# EAGLE board Resistor_Resistor (EAGLE 8.3.0), part 27 of 32
## Placement (x,y rotation side) (continued)
R32948  10K  [0201]  225.3,90.88 0 top
R32949  10K  [0201]  225.3,91.49 0 top
R32950  10K  [0201]  225.3,92.1 0 top
R32951  10K  [0201]  225.3,92.71 0 top
R32952  10K  [0201]  225.3,93.32 0 top
R32953  10K  [0201]  225.3,93.93 0 top
R32954  10K  [0201]  225.3,94.54 0 top
R32955  10K  [0201]  225.3,95.15 0 top
R32956  10K  [0201]  225.3,95.76 0 top
R32957  10K  [0201]  225.3,96.37 0 top
R32958  10K  [0201]  225.3,96.98 0 top
R32959  10K  [0201]  225.3,97.59 0 top
R32960  10K  [0201]  225.3,98.2 0 top
R32961  10K  [0201]  225.3,98.81 0 top
R32962  10K  [0201]  225.3,99.42 0 top
R32963  10K  [0201]  225.3,100.03 0 top
R32964  10K  [0201]  225.3,100.63 0 top
R32965  10K  [0201]  225.3,101.24 0 top
R32966  10K  [0201]  225.3,101.85 0 top
R32967  10K  [0201]  225.3,102.46 0 top
R32968  10K  [0201]  225.3,103.07 0 top
R32969  10K  [0201]  225.3,103.68 0 top
R32970  10K  [0201]  225.3,104.29 0 top
R32971  10K  [0201]  225.3,104.9 0 top
R32972  10K  [0201]  225.3,105.51 0 top
R32973  10K  [0201]  225.3,106.12 0 top
R32974  10K  [0201]  225.3,106.73 0 top
R32975  10K  [0201]  225.3,107.34 0 top
R32976  10K  [0201]  225.3,107.95 0 top
R32977  10K  [0201]  225.3,108.56 0 top
R32978  10K  [0201]  225.3,109.17 0 top
R32979  10K  [0201]  225.3,109.78 0 top
R32980  10K  [0201]  225.3,110.39 0 top
R32981  10K  [0201]  225.3,111 0 top
R32982  10K  [0201]  225.3,111.61 0 top
R32983  10K  [0201]  225.3,112.22 0 top
R32984  10K  [0201]  225.3,112.83 0 top
R32985  10K  [0201]  225.3,113.44 0 top
R32986  10K  [0201]  225.3,114.05 0 top
R32987  10K  [0201]  225.3,114.66 0 top
R32988  10K  [0201]  225.3,115.27 0 top
R32989  10K  [0201]  225.3,115.87 0 top
R32990  10K  [0201]  225.3,116.48 0 top
R32991  10K  [0201]  225.3,117.09 0 top
R32992  10K  [0201]  225.3,117.7 0 top
R32993  10K  [0201]  225.3,118.31 0 top
R32994  10K  [0201]  225.3,118.92 0 top
R32995  10K  [0201]  225.3,119.53 0 top
R32996  10K  [0201]  225.3,120.14 0 top
R32997  10K  [0201]  225.3,120.75 0 top
R32998  10K  [0201]  225.3,121.36 0 top
R32999  10K  [0201]  225.3,121.97 0 top
R33000  10K  [0201]  225.3,122.58 0 top
R33001  10K  [0201]  226.52,1.27 0 top
R33002  10K  [0201]  226.52,1.88 0 top
R33003  10K  [0201]  226.52,2.49 0 top
R33004  10K  [0201]  226.52,3.1 0 top
R33005  10K  [0201]  226.52,3.71 0 top
R33006  10K  [0201]  226.52,4.32 0 top
R33007  10K  [0201]  226.52,4.93 0 top
R33008  10K  [0201]  226.52,5.54 0 top
R33009  10K  [0201]  226.52,6.15 0 top
R33010  10K  [0201]  226.52,6.76 0 top
R33011  10K  [0201]  226.52,7.37 0 top
R33012  10K  [0201]  226.52,7.98 0 top
R33013  10K  [0201]  226.52,8.59 0 top
R33014  10K  [0201]  226.52,9.19 0 top
R33015  10K  [0201]  226.52,9.8 0 top
R33016  10K  [0201]  226.52,10.41 0 top
R33017  10K  [0201]  226.52,11.02 0 top
R33018  10K  [0201]  226.52,11.63 0 top
R33019  10K  [0201]  226.52,12.24 0 top
R33020  10K  [0201]  226.52,12.85 0 top
R33021  10K  [0201]  226.52,13.46 0 top
R33022  10K  [0201]  226.52,14.07 0 top
R33023  10K  [0201]  226.52,14.68 0 top
R33024  10K  [0201]  226.52,15.29 0 top
R33025  10K  [0201]  226.52,15.9 0 top
R33026  10K  [0201]  226.52,16.51 0 top
R33027  10K  [0201]  226.52,17.12 0 top
R33028  10K  [0201]  226.52,17.73 0 top
R33029  10K  [0201]  226.52,18.34 0 top
R33030  10K  [0201]  226.52,18.95 0 top
R33031  10K  [0201]  226.52,19.56 0 top
R33032  10K  [0201]  226.52,20.17 0 top
R33033  10K  [0201]  226.52,20.78 0 top
R33034  10K  [0201]  226.52,21.39 0 top
R33035  10K  [0201]  226.52,22 0 top
R33036  10K  [0201]  226.52,22.61 0 top
R33037  10K  [0201]  226.52,23.22 0 top
R33038  10K  [0201]  226.52,23.83 0 top
R33039  10K  [0201]  226.52,24.43 0 top
R33040  10K  [0201]  226.52,25.04 0 top
R33041  10K  [0201]  226.52,25.65 0 top
R33042  10K  [0201]  226.52,26.26 0 top
R33043  10K  [0201]  226.52,26.87 0 top
R33044  10K  [0201]  226.52,27.48 0 top
R33045  10K  [0201]  226.52,28.09 0 top
R33046  10K  [0201]  226.52,28.7 0 top
R33047  10K  [0201]  226.52,29.31 0 top
R33048  10K  [0201]  226.52,29.92 0 top
R33049  10K  [0201]  226.52,30.53 0 top
R33050  10K  [0201]  226.52,31.14 0 top
R33051  10K  [0201]  226.52,31.75 0 top
R33052  10K  [0201]  226.52,32.36 0 top
R33053  10K  [0201]  226.52,32.97 0 top
R33054  10K  [0201]  226.52,33.58 0 top
R33055  10K  [0201]  226.52,34.19 0 top
R33056  10K  [0201]  226.52,34.8 0 top
R33057  10K  [0201]  226.52,35.41 0 top
R33058  10K  [0201]  226.52,36.02 0 top
R33059  10K  [0201]  226.52,36.63 0 top
R33060  10K  [0201]  226.52,37.24 0 top
R33061  10K  [0201]  226.52,37.85 0 top
R33062  10K  [0201]  226.52,38.46 0 top
R33063  10K  [0201]  226.52,39.07 0 top
R33064  10K  [0201]  226.52,39.67 0 top
R33065  10K  [0201]  226.52,40.28 0 top
R33066  10K  [0201]  226.52,40.89 0 top
R33067  10K  [0201]  226.52,41.5 0 top
R33068  10K  [0201]  226.52,42.11 0 top
R33069  10K  [0201]  226.52,42.72 0 top
R33070  10K  [0201]  226.52,43.33 0 top
R33071  10K  [0201]  226.52,43.94 0 top
R33072  10K  [0201]  226.52,44.55 0 top
R33073  10K  [0201]  226.52,45.16 0 top
R33074  10K  [0201]  226.52,45.77 0 top
R33075  10K  [0201]  226.52,46.38 0 top
R33076  10K  [0201]  226.52,46.99 0 top
R33077  10K  [0201]  226.52,47.6 0 top
R33078  10K  [0201]  226.52,48.21 0 top
R33079  10K  [0201]  226.52,48.82 0 top
R33080  10K  [0201]  226.52,49.43 0 top
R33081  10K  [0201]  226.52,50.04 0 top
R33082  10K  [0201]  226.52,50.65 0 top
R33083  10K  [0201]  226.52,51.26 0 top
R33084  10K  [0201]  226.52,51.87 0 top
R33085  10K  [0201]  226.52,52.48 0 top
R33086  10K  [0201]  226.52,53.09 0 top
R33087  10K  [0201]  226.52,53.7 0 top
R33088  10K  [0201]  226.52,54.31 0 top
R33089  10K  [0201]  226.52,54.91 0 top
R33090  10K  [0201]  226.52,55.52 0 top
R33091  10K  [0201]  226.52,56.13 0 top
R33092  10K  [0201]  226.52,56.74 0 top
R33093  10K  [0201]  226.52,57.35 0 top
R33094  10K  [0201]  226.52,57.96 0 top
R33095  10K  [0201]  226.52,58.57 0 top
R33096  10K  [0201]  226.52,59.18 0 top
R33097  10K  [0201]  226.52,59.79 0 top
R33098  10K  [0201]  226.52,60.4 0 top
R33099  10K  [0201]  226.52,61.01 0 top
R33100  10K  [0201]  226.52,61.62 0 top
R33101  10K  [0201]  226.52,62.23 0 top
R33102  10K  [0201]  226.52,62.84 0 top
R33103  10K  [0201]  226.52,63.45 0 top
R33104  10K  [0201]  226.52,64.06 0 top
R33105  10K  [0201]  226.52,64.67 0 top
R33106  10K  [0201]  226.52,65.28 0 top
R33107  10K  [0201]  226.52,65.89 0 top
R33108  10K  [0201]  226.52,66.5 0 top
R33109  10K  [0201]  226.52,67.11 0 top
R33110  10K  [0201]  226.52,67.72 0 top
R33111  10K  [0201]  226.52,68.33 0 top
R33112  10K  [0201]  226.52,68.94 0 top
R33113  10K  [0201]  226.52,69.55 0 top
R33114  10K  [0201]  226.52,70.15 0 top
R33115  10K  [0201]  226.52,70.76 0 top
R33116  10K  [0201]  226.52,71.37 0 top
R33117  10K  [0201]  226.52,71.98 0 top
R33118  10K  [0201]  226.52,72.59 0 top
R33119  10K  [0201]  226.52,73.2 0 top
R33120  10K  [0201]  226.52,73.81 0 top
R33121  10K  [0201]  226.52,74.42 0 top
R33122  10K  [0201]  226.52,75.03 0 top
R33123  10K  [0201]  226.52,75.64 0 top
R33124  10K  [0201]  226.52,76.25 0 top
R33125  10K  [0201]  226.52,76.86 0 top
R33126  10K  [0201]  226.52,77.47 0 top
R33127  10K  [0201]  226.52,78.08 0 top
R33128  10K  [0201]  226.52,78.69 0 top
R33129  10K  [0201]  226.52,79.3 0 top
R33130  10K  [0201]  226.52,79.91 0 top
R33131  10K  [0201]  226.52,80.52 0 top
R33132  10K  [0201]  226.52,81.13 0 top
R33133  10K  [0201]  226.52,81.74 0 top
R33134  10K  [0201]  226.52,82.35 0 top
R33135  10K  [0201]  226.52,82.96 0 top
R33136  10K  [0201]  226.52,83.57 0 top
R33137  10K  [0201]  226.52,84.18 0 top
R33138  10K  [0201]  226.52,84.79 0 top
R33139  10K  [0201]  226.52,85.39 0 top
R33140  10K  [0201]  226.52,86 0 top
R33141  10K  [0201]  226.52,86.61 0 top
R33142  10K  [0201]  226.52,87.22 0 top
R33143  10K  [0201]  226.52,87.83 0 top
R33144  10K  [0201]  226.52,88.44 0 top
R33145  10K  [0201]  226.52,89.05 0 top
R33146  10K  [0201]  226.52,89.66 0 top
R33147  10K  [0201]  226.52,90.27 0 top
R33148  10K  [0201]  226.52,90.88 0 top
R33149  10K  [0201]  226.52,91.49 0 top
R33150  10K  [0201]  226.52,92.1 0 top
R33151  10K  [0201]  226.52,92.71 0 top
R33152  10K  [0201]  226.52,93.32 0 top
R33153  10K  [0201]  226.52,93.93 0 top
R33154  10K  [0201]  226.52,94.54 0 top
R33155  10K  [0201]  226.52,95.15 0 top
R33156  10K  [0201]  226.52,95.76 0 top
R33157  10K  [0201]  226.52,96.37 0 top
R33158  10K  [0201]  226.52,96.98 0 top
R33159  10K  [0201]  226.52,97.59 0 top
R33160  10K  [0201]  226.52,98.2 0 top
R33161  10K  [0201]  226.52,98.81 0 top
R33162  10K  [0201]  226.52,99.42 0 top
R33163  10K  [0201]  226.52,100.03 0 top
R33164  10K  [0201]  226.52,100.63 0 top
R33165  10K  [0201]  226.52,101.24 0 top
R33166  10K  [0201]  226.52,101.85 0 top
R33167  10K  [0201]  226.52,102.46 0 top
R33168  10K  [0201]  226.52,103.07 0 top
R33169  10K  [0201]  226.52,103.68 0 top
R33170  10K  [0201]  226.52,104.29 0 top
R33171  10K  [0201]  226.52,104.9 0 top
R33172  10K  [0201]  226.52,105.51 0 top
R33173  10K  [0201]  226.52,106.12 0 top
R33174  10K  [0201]  226.52,106.73 0 top
R33175  10K  [0201]  226.52,107.34 0 top
R33176  10K  [0201]  226.52,107.95 0 top
R33177  10K  [0201]  226.52,108.56 0 top
R33178  10K  [0201]  226.52,109.17 0 top
R33179  10K  [0201]  226.52,109.78 0 top
R33180  10K  [0201]  226.52,110.39 0 top
R33181  10K  [0201]  226.52,111 0 top
R33182  10K  [0201]  226.52,111.61 0 top
R33183  10K  [0201]  226.52,112.22 0 top
R33184  10K  [0201]  226.52,112.83 0 top
R33185  10K  [0201]  226.52,113.44 0 top
R33186  10K  [0201]  226.52,114.05 0 top
R33187  10K  [0201]  226.52,114.66 0 top
R33188  10K  [0201]  226.52,115.27 0 top
R33189  10K  [0201]  226.52,115.87 0 top
R33190  10K  [0201]  226.52,116.48 0 top
R33191  10K  [0201]  226.52,117.09 0 top
R33192  10K  [0201]  226.52,117.7 0 top
R33193  10K  [0201]  226.52,118.31 0 top
R33194  10K  [0201]  226.52,118.92 0 top
R33195  10K  [0201]  226.52,119.53 0 top
R33196  10K  [0201]  226.52,120.14 0 top
R33197  10K  [0201]  226.52,120.75 0 top
R33198  10K  [0201]  226.52,121.36 0 top
R33199  10K  [0201]  226.52,121.97 0 top
R33200  10K  [0201]  226.52,122.58 0 top
R33201  10K  [0201]  227.74,1.27 0 top
R33202  10K  [0201]  227.74,1.88 0 top
R33203  10K  [0201]  227.74,2.49 0 top
R33204  10K  [0201]  227.74,3.1 0 top
R33205  10K  [0201]  227.74,3.71 0 top
R33206  10K  [0201]  227.74,4.32 0 top
R33207  10K  [0201]  227.74,4.93 0 top
R33208  10K  [0201]  227.74,5.54 0 top
R33209  10K  [0201]  227.74,6.15 0 top
R33210  10K  [0201]  227.74,6.76 0 top
R33211  10K  [0201]  227.74,7.37 0 top
R33212  10K  [0201]  227.74,7.98 0 top
R33213  10K  [0201]  227.74,8.59 0 top
R33214  10K  [0201]  227.74,9.19 0 top
R33215  10K  [0201]  227.74,9.8 0 top
R33216  10K  [0201]  227.74,10.41 0 top
R33217  10K  [0201]  227.74,11.02 0 top
R33218  10K  [0201]  227.74,11.63 0 top
R33219  10K  [0201]  227.74,12.24 0 top
R33220  10K  [0201]  227.74,12.85 0 top
R33221  10K  [0201]  227.74,13.46 0 top
R33222  10K  [0201]  227.74,14.07 0 top
R33223  10K  [0201]  227.74,14.68 0 top
R33224  10K  [0201]  227.74,15.29 0 top
R33225  10K  [0201]  227.74,15.9 0 top
R33226  10K  [0201]  227.74,16.51 0 top
R33227  10K  [0201]  227.74,17.12 0 top
R33228  10K  [0201]  227.74,17.73 0 top
R33229  10K  [0201]  227.74,18.34 0 top
R33230  10K  [0201]  227.74,18.95 0 top
R33231  10K  [0201]  227.74,19.56 0 top
R33232  10K  [0201]  227.74,20.17 0 top
R33233  10K  [0201]  227.74,20.78 0 top
R33234  10K  [0201]  227.74,21.39 0 top
R33235  10K  [0201]  227.74,22 0 top
R33236  10K  [0201]  227.74,22.61 0 top
R33237  10K  [0201]  227.74,23.22 0 top
R33238  10K  [0201]  227.74,23.83 0 top
R33239  10K  [0201]  227.74,24.43 0 top
R33240  10K  [0201]  227.74,25.04 0 top
R33241  10K  [0201]  227.74,25.65 0 top
R33242  10K  [0201]  227.74,26.26 0 top
R33243  10K  [0201]  227.74,26.87 0 top
R33244  10K  [0201]  227.74,27.48 0 top
R33245  10K  [0201]  227.74,28.09 0 top
R33246  10K  [0201]  227.74,28.7 0 top
R33247  10K  [0201]  227.74,29.31 0 top
R33248  10K  [0201]  227.74,29.92 0 top
R33249  10K  [0201]  227.74,30.53 0 top
R33250  10K  [0201]  227.74,31.14 0 top
R33251  10K  [0201]  227.74,31.75 0 top
R33252  10K  [0201]  227.74,32.36 0 top
R33253  10K  [0201]  227.74,32.97 0 top
R33254  10K  [0201]  227.74,33.58 0 top
R33255  10K  [0201]  227.74,34.19 0 top
R33256  10K  [0201]  227.74,34.8 0 top
R33257  10K  [0201]  227.74,35.41 0 top
R33258  10K  [0201]  227.74,36.02 0 top
R33259  10K  [0201]  227.74,36.63 0 top
R33260  10K  [0201]  227.74,37.24 0 top
R33261  10K  [0201]  227.74,37.85 0 top
R33262  10K  [0201]  227.74,38.46 0 top
R33263  10K  [0201]  227.74,39.07 0 top
R33264  10K  [0201]  227.74,39.67 0 top
R33265  10K  [0201]  227.74,40.28 0 top
R33266  10K  [0201]  227.74,40.89 0 top
R33267  10K  [0201]  227.74,41.5 0 top
R33268  10K  [0201]  227.74,42.11 0 top
R33269  10K  [0201]  227.74,42.72 0 top
R33270  10K  [0201]  227.74,43.33 0 top
R33271  10K  [0201]  227.74,43.94 0 top
R33272  10K  [0201]  227.74,44.55 0 top
R33273  10K  [0201]  227.74,45.16 0 top
R33274  10K  [0201]  227.74,45.77 0 top
R33275  10K  [0201]  227.74,46.38 0 top
R33276  10K  [0201]  227.74,46.99 0 top
R33277  10K  [0201]  227.74,47.6 0 top
R33278  10K  [0201]  227.74,48.21 0 top
R33279  10K  [0201]  227.74,48.82 0 top
R33280  10K  [0201]  227.74,49.43 0 top
R33281  10K  [0201]  227.74,50.04 0 top
R33282  10K  [0201]  227.74,50.65 0 top
R33283  10K  [0201]  227.74,51.26 0 top
R33284  10K  [0201]  227.74,51.87 0 top
R33285  10K  [0201]  227.74,52.48 0 top
R33286  10K  [0201]  227.74,53.09 0 top
R33287  10K  [0201]  227.74,53.7 0 top
R33288  10K  [0201]  227.74,54.31 0 top
R33289  10K  [0201]  227.74,54.91 0 top
R33290  10K  [0201]  227.74,55.52 0 top
R33291  10K  [0201]  227.74,56.13 0 top
R33292  10K  [0201]  227.74,56.74 0 top
R33293  10K  [0201]  227.74,57.35 0 top
R33294  10K  [0201]  227.74,57.96 0 top
R33295  10K  [0201]  227.74,58.57 0 top
R33296  10K  [0201]  227.74,59.18 0 top
R33297  10K  [0201]  227.74,59.79 0 top
R33298  10K  [0201]  227.74,60.4 0 top
R33299  10K  [0201]  227.74,61.01 0 top
R33300  10K  [0201]  227.74,61.62 0 top
R33301  10K  [0201]  227.74,62.23 0 top
R33302  10K  [0201]  227.74,62.84 0 top
R33303  10K  [0201]  227.74,63.45 0 top
R33304  10K  [0201]  227.74,64.06 0 top
R33305  10K  [0201]  227.74,64.67 0 top
R33306  10K  [0201]  227.74,65.28 0 top
R33307  10K  [0201]  227.74,65.89 0 top
R33308  10K  [0201]  227.74,66.5 0 top
R33309  10K  [0201]  227.74,67.11 0 top
R33310  10K  [0201]  227.74,67.72 0 top
R33311  10K  [0201]  227.74,68.33 0 top
R33312  10K  [0201]  227.74,68.94 0 top
R33313  10K  [0201]  227.74,69.55 0 top
R33314  10K  [0201]  227.74,70.15 0 top
R33315  10K  [0201]  227.74,70.76 0 top
R33316  10K  [0201]  227.74,71.37 0 top
R33317  10K  [0201]  227.74,71.98 0 top
R33318  10K  [0201]  227.74,72.59 0 top
R33319  10K  [0201]  227.74,73.2 0 top
R33320  10K  [0201]  227.74,73.81 0 top
R33321  10K  [0201]  227.74,74.42 0 top
R33322  10K  [0201]  227.74,75.03 0 top
R33323  10K  [0201]  227.74,75.64 0 top
R33324  10K  [0201]  227.74,76.25 0 top
R33325  10K  [0201]  227.74,76.86 0 top
R33326  10K  [0201]  227.74,77.47 0 top
R33327  10K  [0201]  227.74,78.08 0 top
R33328  10K  [0201]  227.74,78.69 0 top
R33329  10K  [0201]  227.74,79.3 0 top
R33330  10K  [0201]  227.74,79.91 0 top
R33331  10K  [0201]  227.74,80.52 0 top
R33332  10K  [0201]  227.74,81.13 0 top
R33333  10K  [0201]  227.74,81.74 0 top
R33334  10K  [0201]  227.74,82.35 0 top
R33335  10K  [0201]  227.74,82.96 0 top
R33336  10K  [0201]  227.74,83.57 0 top
R33337  10K  [0201]  227.74,84.18 0 top
R33338  10K  [0201]  227.74,84.79 0 top
R33339  10K  [0201]  227.74,85.39 0 top
R33340  10K  [0201]  227.74,86 0 top
R33341  10K  [0201]  227.74,86.61 0 top
R33342  10K  [0201]  227.74,87.22 0 top
R33343  10K  [0201]  227.74,87.83 0 top
R33344  10K  [0201]  227.74,88.44 0 top
R33345  10K  [0201]  227.74,89.05 0 top
R33346  10K  [0201]  227.74,89.66 0 top
R33347  10K  [0201]  227.74,90.27 0 top
R33348  10K  [0201]  227.74,90.88 0 top
R33349  10K  [0201]  227.74,91.49 0 top
R33350  10K  [0201]  227.74,92.1 0 top
R33351  10K  [0201]  227.74,92.71 0 top
R33352  10K  [0201]  227.74,93.32 0 top
R33353  10K  [0201]  227.74,93.93 0 top
R33354  10K  [0201]  227.74,94.54 0 top
R33355  10K  [0201]  227.74,95.15 0 top
R33356  10K  [0201]  227.74,95.76 0 top
R33357  10K  [0201]  227.74,96.37 0 top
R33358  10K  [0201]  227.74,96.98 0 top
R33359  10K  [0201]  227.74,97.59 0 top
R33360  10K  [0201]  227.74,98.2 0 top
R33361  10K  [0201]  227.74,98.81 0 top
R33362  10K  [0201]  227.74,99.42 0 top
R33363  10K  [0201]  227.74,100.03 0 top
R33364  10K  [0201]  227.74,100.63 0 top
R33365  10K  [0201]  227.74,101.24 0 top
R33366  10K  [0201]  227.74,101.85 0 top
R33367  10K  [0201]  227.74,102.46 0 top
R33368  10K  [0201]  227.74,103.07 0 top
R33369  10K  [0201]  227.74,103.68 0 top
R33370  10K  [0201]  227.74,104.29 0 top
R33371  10K  [0201]  227.74,104.9 0 top
R33372  10K  [0201]  227.74,105.51 0 top
R33373  10K  [0201]  227.74,106.12 0 top
R33374  10K  [0201]  227.74,106.73 0 top
R33375  10K  [0201]  227.74,107.34 0 top
R33376  10K  [0201]  227.74,107.95 0 top
R33377  10K  [0201]  227.74,108.56 0 top
R33378  10K  [0201]  227.74,109.17 0 top
R33379  10K  [0201]  227.74,109.78 0 top
R33380  10K  [0201]  227.74,110.39 0 top
R33381  10K  [0201]  227.74,111 0 top
R33382  10K  [0201]  227.74,111.61 0 top
R33383  10K  [0201]  227.74,112.22 0 top
R33384  10K  [0201]  227.74,112.83 0 top
R33385  10K  [0201]  227.74,113.44 0 top
R33386  10K  [0201]  227.74,114.05 0 top
R33387  10K  [0201]  227.74,114.66 0 top
R33388  10K  [0201]  227.74,115.27 0 top
R33389  10K  [0201]  227.74,115.87 0 top
R33390  10K  [0201]  227.74,116.48 0 top
R33391  10K  [0201]  227.74,117.09 0 top
R33392  10K  [0201]  227.74,117.7 0 top
R33393  10K  [0201]  227.74,118.31 0 top
R33394  10K  [0201]  227.74,118.92 0 top
R33395  10K  [0201]  227.74,119.53 0 top
R33396  10K  [0201]  227.74,120.14 0 top
R33397  10K  [0201]  227.74,120.75 0 top
R33398  10K  [0201]  227.74,121.36 0 top
R33399  10K  [0201]  227.74,121.97 0 top
R33400  10K  [0201]  227.74,122.58 0 top
R33401  10K  [0201]  228.96,1.27 0 top
R33402  10K  [0201]  228.96,1.88 0 top
R33403  10K  [0201]  228.96,2.49 0 top
R33404  10K  [0201]  228.96,3.1 0 top
R33405  10K  [0201]  228.96,3.71 0 top
R33406  10K  [0201]  228.96,4.32 0 top
R33407  10K  [0201]  228.96,4.93 0 top
R33408  10K  [0201]  228.96,5.54 0 top
R33409  10K  [0201]  228.96,6.15 0 top
R33410  10K  [0201]  228.96,6.76 0 top
R33411  10K  [0201]  228.96,7.37 0 top
R33412  10K  [0201]  228.96,7.98 0 top
R33413  10K  [0201]  228.96,8.59 0 top
R33414  10K  [0201]  228.96,9.19 0 top
R33415  10K  [0201]  228.96,9.8 0 top
R33416  10K  [0201]  228.96,10.41 0 top
R33417  10K  [0201]  228.96,11.02 0 top
R33418  10K  [0201]  228.96,11.63 0 top
R33419  10K  [0201]  228.96,12.24 0 top
R33420  10K  [0201]  228.96,12.85 0 top
R33421  10K  [0201]  228.96,13.46 0 top
R33422  10K  [0201]  228.96,14.07 0 top
R33423  10K  [0201]  228.96,14.68 0 top
R33424  10K  [0201]  228.96,15.29 0 top
R33425  10K  [0201]  228.96,15.9 0 top
R33426  10K  [0201]  228.96,16.51 0 top
R33427  10K  [0201]  228.96,17.12 0 top
R33428  10K  [0201]  228.96,17.73 0 top
R33429  10K  [0201]  228.96,18.34 0 top
R33430  10K  [0201]  228.96,18.95 0 top
R33431  10K  [0201]  228.96,19.56 0 top
R33432  10K  [0201]  228.96,20.17 0 top
R33433  10K  [0201]  228.96,20.78 0 top
R33434  10K  [0201]  228.96,21.39 0 top
R33435  10K  [0201]  228.96,22 0 top
R33436  10K  [0201]  228.96,22.61 0 top
R33437  10K  [0201]  228.96,23.22 0 top
R33438  10K  [0201]  228.96,23.83 0 top
R33439  10K  [0201]  228.96,24.43 0 top
R33440  10K  [0201]  228.96,25.04 0 top
R33441  10K  [0201]  228.96,25.65 0 top
R33442  10K  [0201]  228.96,26.26 0 top
R33443  10K  [0201]  228.96,26.87 0 top
R33444  10K  [0201]  228.96,27.48 0 top
R33445  10K  [0201]  228.96,28.09 0 top
R33446  10K  [0201]  228.96,28.7 0 top
R33447  10K  [0201]  228.96,29.31 0 top
R33448  10K  [0201]  228.96,29.92 0 top
R33449  10K  [0201]  228.96,30.53 0 top
R33450  10K  [0201]  228.96,31.14 0 top
R33451  10K  [0201]  228.96,31.75 0 top
R33452  10K  [0201]  228.96,32.36 0 top
R33453  10K  [0201]  228.96,32.97 0 top
R33454  10K  [0201]  228.96,33.58 0 top
R33455  10K  [0201]  228.96,34.19 0 top
R33456  10K  [0201]  228.96,34.8 0 top
R33457  10K  [0201]  228.96,35.41 0 top
R33458  10K  [0201]  228.96,36.02 0 top
R33459  10K  [0201]  228.96,36.63 0 top
R33460  10K  [0201]  228.96,37.24 0 top
R33461  10K  [0201]  228.96,37.85 0 top
R33462  10K  [0201]  228.96,38.46 0 top
R33463  10K  [0201]  228.96,39.07 0 top
R33464  10K  [0201]  228.96,39.67 0 top
R33465  10K  [0201]  228.96,40.28 0 top
R33466  10K  [0201]  228.96,40.89 0 top
R33467  10K  [0201]  228.96,41.5 0 top
R33468  10K  [0201]  228.96,42.11 0 top
R33469  10K  [0201]  228.96,42.72 0 top
R33470  10K  [0201]  228.96,43.33 0 top
R33471  10K  [0201]  228.96,43.94 0 top
R33472  10K  [0201]  228.96,44.55 0 top
R33473  10K  [0201]  228.96,45.16 0 top
R33474  10K  [0201]  228.96,45.77 0 top
R33475  10K  [0201]  228.96,46.38 0 top
R33476  10K  [0201]  228.96,46.99 0 top
R33477  10K  [0201]  228.96,47.6 0 top
R33478  10K  [0201]  228.96,48.21 0 top
R33479  10K  [0201]  228.96,48.82 0 top
R33480  10K  [0201]  228.96,49.43 0 top
R33481  10K  [0201]  228.96,50.04 0 top
R33482  10K  [0201]  228.96,50.65 0 top
R33483  10K  [0201]  228.96,51.26 0 top
R33484  10K  [0201]  228.96,51.87 0 top
R33485  10K  [0201]  228.96,52.48 0 top
R33486  10K  [0201]  228.96,53.09 0 top
R33487  10K  [0201]  228.96,53.7 0 top
R33488  10K  [0201]  228.96,54.31 0 top
R33489  10K  [0201]  228.96,54.91 0 top
R33490  10K  [0201]  228.96,55.52 0 top
R33491  10K  [0201]  228.96,56.13 0 top
R33492  10K  [0201]  228.96,56.74 0 top
R33493  10K  [0201]  228.96,57.35 0 top
R33494  10K  [0201]  228.96,57.96 0 top
R33495  10K  [0201]  228.96,58.57 0 top
R33496  10K  [0201]  228.96,59.18 0 top
R33497  10K  [0201]  228.96,59.79 0 top
R33498  10K  [0201]  228.96,60.4 0 top
R33499  10K  [0201]  228.96,61.01 0 top
R33500  10K  [0201]  228.96,61.62 0 top
R33501  10K  [0201]  228.96,62.23 0 top
R33502  10K  [0201]  228.96,62.84 0 top
R33503  10K  [0201]  228.96,63.45 0 top
R33504  10K  [0201]  228.96,64.06 0 top
R33505  10K  [0201]  228.96,64.67 0 top
R33506  10K  [0201]  228.96,65.28 0 top
R33507  10K  [0201]  228.96,65.89 0 top
R33508  10K  [0201]  228.96,66.5 0 top
R33509  10K  [0201]  228.96,67.11 0 top
R33510  10K  [0201]  228.96,67.72 0 top
R33511  10K  [0201]  228.96,68.33 0 top
R33512  10K  [0201]  228.96,68.94 0 top
R33513  10K  [0201]  228.96,69.55 0 top
R33514  10K  [0201]  228.96,70.15 0 top
R33515  10K  [0201]  228.96,70.76 0 top
R33516  10K  [0201]  228.96,71.37 0 top
R33517  10K  [0201]  228.96,71.98 0 top
R33518  10K  [0201]  228.96,72.59 0 top
R33519  10K  [0201]  228.96,73.2 0 top
R33520  10K  [0201]  228.96,73.81 0 top
R33521  10K  [0201]  228.96,74.42 0 top
R33522  10K  [0201]  228.96,75.03 0 top
R33523  10K  [0201]  228.96,75.64 0 top
R33524  10K  [0201]  228.96,76.25 0 top
R33525  10K  [0201]  228.96,76.86 0 top
R33526  10K  [0201]  228.96,77.47 0 top
R33527  10K  [0201]  228.96,78.08 0 top
R33528  10K  [0201]  228.96,78.69 0 top
R33529  10K  [0201]  228.96,79.3 0 top
R33530  10K  [0201]  228.96,79.91 0 top
R33531  10K  [0201]  228.96,80.52 0 top
R33532  10K  [0201]  228.96,81.13 0 top
R33533  10K  [0201]  228.96,81.74 0 top
R33534  10K  [0201]  228.96,82.35 0 top
R33535  10K  [0201]  228.96,82.96 0 top
R33536  10K  [0201]  228.96,83.57 0 top
R33537  10K  [0201]  228.96,84.18 0 top
R33538  10K  [0201]  228.96,84.79 0 top
R33539  10K  [0201]  228.96,85.39 0 top
R33540  10K  [0201]  228.96,86 0 top
R33541  10K  [0201]  228.96,86.61 0 top
R33542  10K  [0201]  228.96,87.22 0 top
R33543  10K  [0201]  228.96,87.83 0 top
R33544  10K  [0201]  228.96,88.44 0 top
R33545  10K  [0201]  228.96,89.05 0 top
R33546  10K  [0201]  228.96,89.66 0 top
R33547  10K  [0201]  228.96,90.27 0 top
R33548  10K  [0201]  228.96,90.88 0 top
R33549  10K  [0201]  228.96,91.49 0 top
R33550  10K  [0201]  228.96,92.1 0 top
R33551  10K  [0201]  228.96,92.71 0 top
R33552  10K  [0201]  228.96,93.32 0 top
R33553  10K  [0201]  228.96,93.93 0 top
R33554  10K  [0201]  228.96,94.54 0 top
R33555  10K  [0201]  228.96,95.15 0 top
R33556  10K  [0201]  228.96,95.76 0 top
R33557  10K  [0201]  228.96,96.37 0 top
R33558  10K  [0201]  228.96,96.98 0 top
R33559  10K  [0201]  228.96,97.59 0 top
R33560  10K  [0201]  228.96,98.2 0 top
R33561  10K  [0201]  228.96,98.81 0 top
R33562  10K  [0201]  228.96,99.42 0 top
R33563  10K  [0201]  228.96,100.03 0 top
R33564  10K  [0201]  228.96,100.63 0 top
R33565  10K  [0201]  228.96,101.24 0 top
R33566  10K  [0201]  228.96,101.85 0 top
R33567  10K  [0201]  228.96,102.46 0 top
R33568  10K  [0201]  228.96,103.07 0 top
R33569  10K  [0201]  228.96,103.68 0 top
R33570  10K  [0201]  228.96,104.29 0 top
R33571  10K  [0201]  228.96,104.9 0 top
R33572  10K  [0201]  228.96,105.51 0 top
R33573  10K  [0201]  228.96,106.12 0 top
R33574  10K  [0201]  228.96,106.73 0 top
R33575  10K  [0201]  228.96,107.34 0 top
R33576  10K  [0201]  228.96,107.95 0 top
R33577  10K  [0201]  228.96,108.56 0 top
R33578  10K  [0201]  228.96,109.17 0 top
R33579  10K  [0201]  228.96,109.78 0 top
R33580  10K  [0201]  228.96,110.39 0 top
R33581  10K  [0201]  228.96,111 0 top
R33582  10K  [0201]  228.96,111.61 0 top
R33583  10K  [0201]  228.96,112.22 0 top
R33584  10K  [0201]  228.96,112.83 0 top
R33585  10K  [0201]  228.96,113.44 0 top
R33586  10K  [0201]  228.96,114.05 0 top
R33587  10K  [0201]  228.96,114.66 0 top
R33588  10K  [0201]  228.96,115.27 0 top
R33589  10K  [0201]  228.96,115.87 0 top
R33590  10K  [0201]  228.96,116.48 0 top
R33591  10K  [0201]  228.96,117.09 0 top
R33592  10K  [0201]  228.96,117.7 0 top
R33593  10K  [0201]  228.96,118.31 0 top
R33594  10K  [0201]  228.96,118.92 0 top
R33595  10K  [0201]  228.96,119.53 0 top
R33596  10K  [0201]  228.96,120.14 0 top
R33597  10K  [0201]  228.96,120.75 0 top
R33598  10K  [0201]  228.96,121.36 0 top
R33599  10K  [0201]  228.96,121.97 0 top
R33600  10K  [0201]  228.96,122.58 0 top
R33601  10K  [0201]  230.17,1.27 0 top
R33602  10K  [0201]  230.17,1.88 0 top
R33603  10K  [0201]  230.17,2.49 0 top
R33604  10K  [0201]  230.17,3.1 0 top
R33605  10K  [0201]  230.17,3.71 0 top
R33606  10K  [0201]  230.17,4.32 0 top
R33607  10K  [0201]  230.17,4.93 0 top
R33608  10K  [0201]  230.17,5.54 0 top
R33609  10K  [0201]  230.17,6.15 0 top
R33610  10K  [0201]  230.17,6.76 0 top
R33611  10K  [0201]  230.17,7.37 0 top
R33612  10K  [0201]  230.17,7.98 0 top
R33613  10K  [0201]  230.17,8.59 0 top
R33614  10K  [0201]  230.17,9.19 0 top
R33615  10K  [0201]  230.17,9.8 0 top
R33616  10K  [0201]  230.17,10.41 0 top
R33617  10K  [0201]  230.17,11.02 0 top
R33618  10K  [0201]  230.17,11.63 0 top
R33619  10K  [0201]  230.17,12.24 0 top
R33620  10K  [0201]  230.17,12.85 0 top
R33621  10K  [0201]  230.17,13.46 0 top
R33622  10K  [0201]  230.17,14.07 0 top
R33623  10K  [0201]  230.17,14.68 0 top
R33624  10K  [0201]  230.17,15.29 0 top
R33625  10K  [0201]  230.17,15.9 0 top
R33626  10K  [0201]  230.17,16.51 0 top
R33627  10K  [0201]  230.17,17.12 0 top
R33628  10K  [0201]  230.17,17.73 0 top
R33629  10K  [0201]  230.17,18.34 0 top
R33630  10K  [0201]  230.17,18.95 0 top
R33631  10K  [0201]  230.17,19.56 0 top
R33632  10K  [0201]  230.17,20.17 0 top
R33633  10K  [0201]  230.17,20.78 0 top
R33634  10K  [0201]  230.17,21.39 0 top
R33635  10K  [0201]  230.17,22 0 top
R33636  10K  [0201]  230.17,22.61 0 top
R33637  10K  [0201]  230.17,23.22 0 top
R33638  10K  [0201]  230.17,23.83 0 top
R33639  10K  [0201]  230.17,24.43 0 top
R33640  10K  [0201]  230.17,25.04 0 top
R33641  10K  [0201]  230.17,25.65 0 top
R33642  10K  [0201]  230.17,26.26 0 top
R33643  10K  [0201]  230.17,26.87 0 top
R33644  10K  [0201]  230.17,27.48 0 top
R33645  10K  [0201]  230.17,28.09 0 top
R33646  10K  [0201]  230.17,28.7 0 top
R33647  10K  [0201]  230.17,29.31 0 top
R33648  10K  [0201]  230.17,29.92 0 top
R33649  10K  [0201]  230.17,30.53 0 top
R33650  10K  [0201]  230.17,31.14 0 top
R33651  10K  [0201]  230.17,31.75 0 top
R33652  10K  [0201]  230.17,32.36 0 top
R33653  10K  [0201]  230.17,32.97 0 top
R33654  10K  [0201]  230.17,33.58 0 top
R33655  10K  [0201]  230.17,34.19 0 top
R33656  10K  [0201]  230.17,34.8 0 top
R33657  10K  [0201]  230.17,35.41 0 top
R33658  10K  [0201]  230.17,36.02 0 top
R33659  10K  [0201]  230.17,36.63 0 top
R33660  10K  [0201]  230.17,37.24 0 top
R33661  10K  [0201]  230.17,37.85 0 top
R33662  10K  [0201]  230.17,38.46 0 top
R33663  10K  [0201]  230.17,39.07 0 top
R33664  10K  [0201]  230.17,39.67 0 top
R33665  10K  [0201]  230.17,40.28 0 top
R33666  10K  [0201]  230.17,40.89 0 top
R33667  10K  [0201]  230.17,41.5 0 top
R33668  10K  [0201]  230.17,42.11 0 top
R33669  10K  [0201]  230.17,42.72 0 top
R33670  10K  [0201]  230.17,43.33 0 top
R33671  10K  [0201]  230.17,43.94 0 top
R33672  10K  [0201]  230.17,44.55 0 top
R33673  10K  [0201]  230.17,45.16 0 top
R33674  10K  [0201]  230.17,45.77 0 top
R33675  10K  [0201]  230.17,46.38 0 top
R33676  10K  [0201]  230.17,46.99 0 top
R33677  10K  [0201]  230.17,47.6 0 top
R33678  10K  [0201]  230.17,48.21 0 top
R33679  10K  [0201]  230.17,48.82 0 top
R33680  10K  [0201]  230.17,49.43 0 top
R33681  10K  [0201]  230.17,50.04 0 top
R33682  10K  [0201]  230.17,50.65 0 top
R33683  10K  [0201]  230.17,51.26 0 top
R33684  10K  [0201]  230.17,51.87 0 top
R33685  10K  [0201]  230.17,52.48 0 top
R33686  10K  [0201]  230.17,53.09 0 top
R33687  10K  [0201]  230.17,53.7 0 top
R33688  10K  [0201]  230.17,54.31 0 top
R33689  10K  [0201]  230.17,54.91 0 top
R33690  10K  [0201]  230.17,55.52 0 top
R33691  10K  [0201]  230.17,56.13 0 top
R33692  10K  [0201]  230.17,56.74 0 top
R33693  10K  [0201]  230.17,57.35 0 top
R33694  10K  [0201]  230.17,57.96 0 top
R33695  10K  [0201]  230.17,58.57 0 top
R33696  10K  [0201]  230.17,59.18 0 top
R33697  10K  [0201]  230.17,59.79 0 top
R33698  10K  [0201]  230.17,60.4 0 top
R33699  10K  [0201]  230.17,61.01 0 top
R33700  10K  [0201]  230.17,61.62 0 top
R33701  10K  [0201]  230.17,62.23 0 top
R33702  10K  [0201]  230.17,62.84 0 top
R33703  10K  [0201]  230.17,63.45 0 top
R33704  10K  [0201]  230.17,64.06 0 top
R33705  10K  [0201]  230.17,64.67 0 top
R33706  10K  [0201]  230.17,65.28 0 top
R33707  10K  [0201]  230.17,65.89 0 top
R33708  10K  [0201]  230.17,66.5 0 top
R33709  10K  [0201]  230.17,67.11 0 top
R33710  10K  [0201]  230.17,67.72 0 top
R33711  10K  [0201]  230.17,68.33 0 top
R33712  10K  [0201]  230.17,68.94 0 top
R33713  10K  [0201]  230.17,69.55 0 top
R33714  10K  [0201]  230.17,70.15 0 top
R33715  10K  [0201]  230.17,70.76 0 top
R33716  10K  [0201]  230.17,71.37 0 top
R33717  10K  [0201]  230.17,71.98 0 top
R33718  10K  [0201]  230.17,72.59 0 top
R33719  10K  [0201]  230.17,73.2 0 top
R33720  10K  [0201]  230.17,73.81 0 top
R33721  10K  [0201]  230.17,74.42 0 top
R33722  10K  [0201]  230.17,75.03 0 top
R33723  10K  [0201]  230.17,75.64 0 top
R33724  10K  [0201]  230.17,76.25 0 top
R33725  10K  [0201]  230.17,76.86 0 top
R33726  10K  [0201]  230.17,77.47 0 top
R33727  10K  [0201]  230.17,78.08 0 top
R33728  10K  [0201]  230.17,78.69 0 top
R33729  10K  [0201]  230.17,79.3 0 top
R33730  10K  [0201]  230.17,79.91 0 top
R33731  10K  [0201]  230.17,80.52 0 top
R33732  10K  [0201]  230.17,81.13 0 top
R33733  10K  [0201]  230.17,81.74 0 top
R33734  10K  [0201]  230.17,82.35 0 top
R33735  10K  [0201]  230.17,82.96 0 top
R33736  10K  [0201]  230.17,83.57 0 top
R33737  10K  [0201]  230.17,84.18 0 top
R33738  10K  [0201]  230.17,84.79 0 top
R33739  10K  [0201]  230.17,85.39 0 top
R33740  10K  [0201]  230.17,86 0 top
R33741  10K  [0201]  230.17,86.61 0 top
R33742  10K  [0201]  230.17,87.22 0 top
R33743  10K  [0201]  230.17,87.83 0 top
R33744  10K  [0201]  230.17,88.44 0 top
R33745  10K  [0201]  230.17,89.05 0 top
R33746  10K  [0201]  230.17,89.66 0 top
R33747  10K  [0201]  230.17,90.27 0 top
R33748  10K  [0201]  230.17,90.88 0 top
R33749  10K  [0201]  230.17,91.49 0 top
R33750  10K  [0201]  230.17,92.1 0 top
R33751  10K  [0201]  230.17,92.71 0 top
R33752  10K  [0201]  230.17,93.32 0 top
R33753  10K  [0201]  230.17,93.93 0 top
R33754  10K  [0201]  230.17,94.54 0 top
R33755  10K  [0201]  230.17,95.15 0 top
R33756  10K  [0201]  230.17,95.76 0 top
R33757  10K  [0201]  230.17,96.37 0 top
R33758  10K  [0201]  230.17,96.98 0 top
R33759  10K  [0201]  230.17,97.59 0 top
R33760  10K  [0201]  230.17,98.2 0 top
R33761  10K  [0201]  230.17,98.81 0 top
R33762  10K  [0201]  230.17,99.42 0 top
R33763  10K  [0201]  230.17,100.03 0 top
R33764  10K  [0201]  230.17,100.63 0 top
R33765  10K  [0201]  230.17,101.24 0 top
R33766  10K  [0201]  230.17,101.85 0 top
R33767  10K  [0201]  230.17,102.46 0 top
R33768  10K  [0201]  230.17,103.07 0 top
R33769  10K  [0201]  230.17,103.68 0 top
R33770  10K  [0201]  230.17,104.29 0 top
R33771  10K  [0201]  230.17,104.9 0 top
R33772  10K  [0201]  230.17,105.51 0 top
R33773  10K  [0201]  230.17,106.12 0 top
R33774  10K  [0201]  230.17,106.73 0 top
R33775  10K  [0201]  230.17,107.34 0 top
R33776  10K  [0201]  230.17,107.95 0 top
R33777  10K  [0201]  230.17,108.56 0 top
R33778  10K  [0201]  230.17,109.17 0 top
R33779  10K  [0201]  230.17,109.78 0 top
R33780  10K  [0201]  230.17,110.39 0 top
R33781  10K  [0201]  230.17,111 0 top
R33782  10K  [0201]  230.17,111.61 0 top
R33783  10K  [0201]  230.17,112.22 0 top
R33784  10K  [0201]  230.17,112.83 0 top
R33785  10K  [0201]  230.17,113.44 0 top
R33786  10K  [0201]  230.17,114.05 0 top
R33787  10K  [0201]  230.17,114.66 0 top
R33788  10K  [0201]  230.17,115.27 0 top
R33789  10K  [0201]  230.17,115.87 0 top
R33790  10K  [0201]  230.17,116.48 0 top
R33791  10K  [0201]  230.17,117.09 0 top
R33792  10K  [0201]  230.17,117.7 0 top
R33793  10K  [0201]  230.17,118.31 0 top
R33794  10K  [0201]  230.17,118.92 0 top
R33795  10K  [0201]  230.17,119.53 0 top
R33796  10K  [0201]  230.17,120.14 0 top
R33797  10K  [0201]  230.17,120.75 0 top
R33798  10K  [0201]  230.17,121.36 0 top
R33799  10K  [0201]  230.17,121.97 0 top
R33800  10K  [0201]  230.17,122.58 0 top
R33801  10K  [0201]  231.39,1.27 0 top
R33802  10K  [0201]  231.39,1.88 0 top
R33803  10K  [0201]  231.39,2.49 0 top
R33804  10K  [0201]  231.39,3.1 0 top
R33805  10K  [0201]  231.39,3.71 0 top
R33806  10K  [0201]  231.39,4.32 0 top
R33807  10K  [0201]  231.39,4.93 0 top
R33808  10K  [0201]  231.39,5.54 0 top
R33809  10K  [0201]  231.39,6.15 0 top
R33810  10K  [0201]  231.39,6.76 0 top
R33811  10K  [0201]  231.39,7.37 0 top
R33812  10K  [0201]  231.39,7.98 0 top
R33813  10K  [0201]  231.39,8.59 0 top
R33814  10K  [0201]  231.39,9.19 0 top
R33815  10K  [0201]  231.39,9.8 0 top
R33816  10K  [0201]  231.39,10.41 0 top
R33817  10K  [0201]  231.39,11.02 0 top
R33818  10K  [0201]  231.39,11.63 0 top
R33819  10K  [0201]  231.39,12.24 0 top
R33820  10K  [0201]  231.39,12.85 0 top
R33821  10K  [0201]  231.39,13.46 0 top
R33822  10K  [0201]  231.39,14.07 0 top
R33823  10K  [0201]  231.39,14.68 0 top
R33824  10K  [0201]  231.39,15.29 0 top
R33825  10K  [0201]  231.39,15.9 0 top
R33826  10K  [0201]  231.39,16.51 0 top
R33827  10K  [0201]  231.39,17.12 0 top
R33828  10K  [0201]  231.39,17.73 0 top
R33829  10K  [0201]  231.39,18.34 0 top
R33830  10K  [0201]  231.39,18.95 0 top
R33831  10K  [0201]  231.39,19.56 0 top
R33832  10K  [0201]  231.39,20.17 0 top
R33833  10K  [0201]  231.39,20.78 0 top
R33834  10K  [0201]  231.39,21.39 0 top
R33835  10K  [0201]  231.39,22 0 top
R33836  10K  [0201]  231.39,22.61 0 top
R33837  10K  [0201]  231.39,23.22 0 top
R33838  10K  [0201]  231.39,23.83 0 top
R33839  10K  [0201]  231.39,24.43 0 top
R33840  10K  [0201]  231.39,25.04 0 top
R33841  10K  [0201]  231.39,25.65 0 top
R33842  10K  [0201]  231.39,26.26 0 top
R33843  10K  [0201]  231.39,26.87 0 top
R33844  10K  [0201]  231.39,27.48 0 top
R33845  10K  [0201]  231.39,28.09 0 top
R33846  10K  [0201]  231.39,28.7 0 top
R33847  10K  [0201]  231.39,29.31 0 top
R33848  10K  [0201]  231.39,29.92 0 top
R33849  10K  [0201]  231.39,30.53 0 top
R33850  10K  [0201]  231.39,31.14 0 top
R33851  10K  [0201]  231.39,31.75 0 top
R33852  10K  [0201]  231.39,32.36 0 top
R33853  10K  [0201]  231.39,32.97 0 top
R33854  10K  [0201]  231.39,33.58 0 top
R33855  10K  [0201]  231.39,34.19 0 top
R33856  10K  [0201]  231.39,34.8 0 top
R33857  10K  [0201]  231.39,35.41 0 top
R33858  10K  [0201]  231.39,36.02 0 top
R33859  10K  [0201]  231.39,36.63 0 top
R33860  10K  [0201]  231.39,37.24 0 top
R33861  10K  [0201]  231.39,37.85 0 top
R33862  10K  [0201]  231.39,38.46 0 top
R33863  10K  [0201]  231.39,39.07 0 top
R33864  10K  [0201]  231.39,39.67 0 top
R33865  10K  [0201]  231.39,40.28 0 top
R33866  10K  [0201]  231.39,40.89 0 top
R33867  10K  [0201]  231.39,41.5 0 top
R33868  10K  [0201]  231.39,42.11 0 top
R33869  10K  [0201]  231.39,42.72 0 top
R33870  10K  [0201]  231.39,43.33 0 top
R33871  10K  [0201]  231.39,43.94 0 top
R33872  10K  [0201]  231.39,44.55 0 top
R33873  10K  [0201]  231.39,45.16 0 top
R33874  10K  [0201]  231.39,45.77 0 top
R33875  10K  [0201]  231.39,46.38 0 top
R33876  10K  [0201]  231.39,46.99 0 top
R33877  10K  [0201]  231.39,47.6 0 top
R33878  10K  [0201]  231.39,48.21 0 top
R33879  10K  [0201]  231.39,48.82 0 top
R33880  10K  [0201]  231.39,49.43 0 top
R33881  10K  [0201]  231.39,50.04 0 top
R33882  10K  [0201]  231.39,50.65 0 top
R33883  10K  [0201]  231.39,51.26 0 top
R33884  10K  [0201]  231.39,51.87 0 top
R33885  10K  [0201]  231.39,52.48 0 top
R33886  10K  [0201]  231.39,53.09 0 top
R33887  10K  [0201]  231.39,53.7 0 top
R33888  10K  [0201]  231.39,54.31 0 top
R33889  10K  [0201]  231.39,54.91 0 top
R33890  10K  [0201]  231.39,55.52 0 top
R33891  10K  [0201]  231.39,56.13 0 top
R33892  10K  [0201]  231.39,56.74 0 top
R33893  10K  [0201]  231.39,57.35 0 top
R33894  10K  [0201]  231.39,57.96 0 top
R33895  10K  [0201]  231.39,58.57 0 top
R33896  10K  [0201]  231.39,59.18 0 top
R33897  10K  [0201]  231.39,59.79 0 top
R33898  10K  [0201]  231.39,60.4 0 top
R33899  10K  [0201]  231.39,61.01 0 top
R33900  10K  [0201]  231.39,61.62 0 top
R33901  10K  [0201]  231.39,62.23 0 top
R33902  10K  [0201]  231.39,62.84 0 top
R33903  10K  [0201]  231.39,63.45 0 top
R33904  10K  [0201]  231.39,64.06 0 top
R33905  10K  [0201]  231.39,64.67 0 top
R33906  10K  [0201]  231.39,65.28 0 top
R33907  10K  [0201]  231.39,65.89 0 top
R33908  10K  [0201]  231.39,66.5 0 top
R33909  10K  [0201]  231.39,67.11 0 top
R33910  10K  [0201]  231.39,67.72 0 top
R33911  10K  [0201]  231.39,68.33 0 top
R33912  10K  [0201]  231.39,68.94 0 top
R33913  10K  [0201]  231.39,69.55 0 top
R33914  10K  [0201]  231.39,70.15 0 top
R33915  10K  [0201]  231.39,70.76 0 top
R33916  10K  [0201]  231.39,71.37 0 top
R33917  10K  [0201]  231.39,71.98 0 top
R33918  10K  [0201]  231.39,72.59 0 top
R33919  10K  [0201]  231.39,73.2 0 top
R33920  10K  [0201]  231.39,73.81 0 top
R33921  10K  [0201]  231.39,74.42 0 top
R33922  10K  [0201]  231.39,75.03 0 top
R33923  10K  [0201]  231.39,75.64 0 top
R33924  10K  [0201]  231.39,76.25 0 top
R33925  10K  [0201]  231.39,76.86 0 top
R33926  10K  [0201]  231.39,77.47 0 top
R33927  10K  [0201]  231.39,78.08 0 top
R33928  10K  [0201]  231.39,78.69 0 top
R33929  10K  [0201]  231.39,79.3 0 top
R33930  10K  [0201]  231.39,79.91 0 top
R33931  10K  [0201]  231.39,80.52 0 top
R33932  10K  [0201]  231.39,81.13 0 top
R33933  10K  [0201]  231.39,81.74 0 top
R33934  10K  [0201]  231.39,82.35 0 top
R33935  10K  [0201]  231.39,82.96 0 top
R33936  10K  [0201]  231.39,83.57 0 top
R33937  10K  [0201]  231.39,84.18 0 top
R33938  10K  [0201]  231.39,84.79 0 top
R33939  10K  [0201]  231.39,85.39 0 top
R33940  10K  [0201]  231.39,86 0 top
R33941  10K  [0201]  231.39,86.61 0 top
R33942  10K  [0201]  231.39,87.22 0 top
R33943  10K  [0201]  231.39,87.83 0 top
R33944  10K  [0201]  231.39,88.44 0 top
R33945  10K  [0201]  231.39,89.05 0 top
R33946  10K  [0201]  231.39,89.66 0 top
R33947  10K  [0201]  231.39,90.27 0 top
R33948  10K  [0201]  231.39,90.88 0 top
R33949  10K  [0201]  231.39,91.49 0 top
R33950  10K  [0201]  231.39,92.1 0 top
R33951  10K  [0201]  231.39,92.71 0 top
R33952  10K  [0201]  231.39,93.32 0 top
R33953  10K  [0201]  231.39,93.93 0 top
R33954  10K  [0201]  231.39,94.54 0 top
R33955  10K  [0201]  231.39,95.15 0 top
R33956  10K  [0201]  231.39,95.76 0 top
R33957  10K  [0201]  231.39,96.37 0 top
R33958  10K  [0201]  231.39,96.98 0 top
R33959  10K  [0201]  231.39,97.59 0 top
R33960  10K  [0201]  231.39,98.2 0 top
R33961  10K  [0201]  231.39,98.81 0 top
R33962  10K  [0201]  231.39,99.42 0 top
R33963  10K  [0201]  231.39,100.03 0 top
R33964  10K  [0201]  231.39,100.63 0 top
R33965  10K  [0201]  231.39,101.24 0 top
R33966  10K  [0201]  231.39,101.85 0 top
R33967  10K  [0201]  231.39,102.46 0 top
R33968  10K  [0201]  231.39,103.07 0 top
R33969  10K  [0201]  231.39,103.68 0 top
R33970  10K  [0201]  231.39,104.29 0 top
R33971  10K  [0201]  231.39,104.9 0 top
R33972  10K  [0201]  231.39,105.51 0 top
R33973  10K  [0201]  231.39,106.12 0 top
R33974  10K  [0201]  231.39,106.73 0 top
R33975  10K  [0201]  231.39,107.34 0 top
R33976  10K  [0201]  231.39,107.95 0 top
R33977  10K  [0201]  231.39,108.56 0 top
R33978  10K  [0201]  231.39,109.17 0 top
R33979  10K  [0201]  231.39,109.78 0 top
R33980  10K  [0201]  231.39,110.39 0 top
R33981  10K  [0201]  231.39,111 0 top
R33982  10K  [0201]  231.39,111.61 0 top
R33983  10K  [0201]  231.39,112.22 0 top
R33984  10K  [0201]  231.39,112.83 0 top
R33985  10K  [0201]  231.39,113.44 0 top
R33986  10K  [0201]  231.39,114.05 0 top
R33987  10K  [0201]  231.39,114.66 0 top
R33988  10K  [0201]  231.39,115.27 0 top
R33989  10K  [0201]  231.39,115.87 0 top
R33990  10K  [0201]  231.39,116.48 0 top
R33991  10K  [0201]  231.39,117.09 0 top
R33992  10K  [0201]  231.39,117.7 0 top
R33993  10K  [0201]  231.39,118.31 0 top
R33994  10K  [0201]  231.39,118.92 0 top
R33995  10K  [0201]  231.39,119.53 0 top
R33996  10K  [0201]  231.39,120.14 0 top
R33997  10K  [0201]  231.39,120.75 0 top
R33998  10K  [0201]  231.39,121.36 0 top
R33999  10K  [0201]  231.39,121.97 0 top
R34000  10K  [0201]  231.39,122.58 0 top
R34001  10K  [0201]  232.61,1.27 0 top
R34002  10K  [0201]  232.61,1.88 0 top
R34003  10K  [0201]  232.61,2.49 0 top
R34004  10K  [0201]  232.61,3.1 0 top
R34005  10K  [0201]  232.61,3.71 0 top
R34006  10K  [0201]  232.61,4.32 0 top
R34007  10K  [0201]  232.61,4.93 0 top
R34008  10K  [0201]  232.61,5.54 0 top
R34009  10K  [0201]  232.61,6.15 0 top
R34010  10K  [0201]  232.61,6.76 0 top
R34011  10K  [0201]  232.61,7.37 0 top
R34012  10K  [0201]  232.61,7.98 0 top
R34013  10K  [0201]  232.61,8.59 0 top
R34014  10K  [0201]  232.61,9.19 0 top
R34015  10K  [0201]  232.61,9.8 0 top
R34016  10K  [0201]  232.61,10.41 0 top
R34017  10K  [0201]  232.61,11.02 0 top
R34018  10K  [0201]  232.61,11.63 0 top
R34019  10K  [0201]  232.61,12.24 0 top
R34020  10K  [0201]  232.61,12.85 0 top
R34021  10K  [0201]  232.61,13.46 0 top
R34022  10K  [0201]  232.61,14.07 0 top
R34023  10K  [0201]  232.61,14.68 0 top
R34024  10K  [0201]  232.61,15.29 0 top
R34025  10K  [0201]  232.61,15.9 0 top
R34026  10K  [0201]  232.61,16.51 0 top
R34027  10K  [0201]  232.61,17.12 0 top
R34028  10K  [0201]  232.61,17.73 0 top
R34029  10K  [0201]  232.61,18.34 0 top
R34030  10K  [0201]  232.61,18.95 0 top
R34031  10K  [0201]  232.61,19.56 0 top
R34032  10K  [0201]  232.61,20.17 0 top
R34033  10K  [0201]  232.61,20.78 0 top
R34034  10K  [0201]  232.61,21.39 0 top
R34035  10K  [0201]  232.61,22 0 top
R34036  10K  [0201]  232.61,22.61 0 top
R34037  10K  [0201]  232.61,23.22 0 top
R34038  10K  [0201]  232.61,23.83 0 top
R34039  10K  [0201]  232.61,24.43 0 top
R34040  10K  [0201]  232.61,25.04 0 top
R34041  10K  [0201]  232.61,25.65 0 top
R34042  10K  [0201]  232.61,26.26 0 top
R34043  10K  [0201]  232.61,26.87 0 top
R34044  10K  [0201]  232.61,27.48 0 top
R34045  10K  [0201]  232.61,28.09 0 top
R34046  10K  [0201]  232.61,28.7 0 top
R34047  10K  [0201]  232.61,29.31 0 top
R34048  10K  [0201]  232.61,29.92 0 top
R34049  10K  [0201]  232.61,30.53 0 top
R34050  10K  [0201]  232.61,31.14 0 top
R34051  10K  [0201]  232.61,31.75 0 top
R34052  10K  [0201]  232.61,32.36 0 top
R34053  10K  [0201]  232.61,32.97 0 top
R34054  10K  [0201]  232.61,33.58 0 top
R34055  10K  [0201]  232.61,34.19 0 top
R34056  10K  [0201]  232.61,34.8 0 top
R34057  10K  [0201]  232.61,35.41 0 top
R34058  10K  [0201]  232.61,36.02 0 top
R34059  10K  [0201]  232.61,36.63 0 top
R34060  10K  [0201]  232.61,37.24 0 top
R34061  10K  [0201]  232.61,37.85 0 top
R34062  10K  [0201]  232.61,38.46 0 top
R34063  10K  [0201]  232.61,39.07 0 top
R34064  10K  [0201]  232.61,39.67 0 top
R34065  10K  [0201]  232.61,40.28 0 top
R34066  10K  [0201]  232.61,40.89 0 top
R34067  10K  [0201]  232.61,41.5 0 top
R34068  10K  [0201]  232.61,42.11 0 top
R34069  10K  [0201]  232.61,42.72 0 top
R34070  10K  [0201]  232.61,43.33 0 top
R34071  10K  [0201]  232.61,43.94 0 top
R34072  10K  [0201]  232.61,44.55 0 top
R34073  10K  [0201]  232.61,45.16 0 top
R34074  10K  [0201]  232.61,45.77 0 top
R34075  10K  [0201]  232.61,46.38 0 top
R34076  10K  [0201]  232.61,46.99 0 top
R34077  10K  [0201]  232.61,47.6 0 top
R34078  10K  [0201]  232.61,48.21 0 top
R34079  10K  [0201]  232.61,48.82 0 top
R34080  10K  [0201]  232.61,49.43 0 top
R34081  10K  [0201]  232.61,50.04 0 top
R34082  10K  [0201]  232.61,50.65 0 top
R34083  10K  [0201]  232.61,51.26 0 top
R34084  10K  [0201]  232.61,51.87 0 top
R34085  10K  [0201]  232.61,52.48 0 top
R34086  10K  [0201]  232.61,53.09 0 top
R34087  10K  [0201]  232.61,53.7 0 top
R34088  10K  [0201]  232.61,54.31 0 top
R34089  10K  [0201]  232.61,54.91 0 top
R34090  10K  [0201]  232.61,55.52 0 top
R34091  10K  [0201]  232.61,56.13 0 top
R34092  10K  [0201]  232.61,56.74 0 top
R34093  10K  [0201]  232.61,57.35 0 top
R34094  10K  [0201]  232.61,57.96 0 top
R34095  10K  [0201]  232.61,58.57 0 top
R34096  10K  [0201]  232.61,59.18 0 top
R34097  10K  [0201]  232.61,59.79 0 top
R34098  10K  [0201]  232.61,60.4 0 top
R34099  10K  [0201]  232.61,61.01 0 top
R34100  10K  [0201]  232.61,61.62 0 top
R34101  10K  [0201]  232.61,62.23 0 top
R34102  10K  [0201]  232.61,62.84 0 top
R34103  10K  [0201]  232.61,63.45 0 top
R34104  10K  [0201]  232.61,64.06 0 top
R34105  10K  [0201]  232.61,64.67 0 top
R34106  10K  [0201]  232.61,65.28 0 top
R34107  10K  [0201]  232.61,65.89 0 top
R34108  10K  [0201]  232.61,66.5 0 top
R34109  10K  [0201]  232.61,67.11 0 top
R34110  10K  [0201]  232.61,67.72 0 top
R34111  10K  [0201]  232.61,68.33 0 top
R34112  10K  [0201]  232.61,68.94 0 top
R34113  10K  [0201]  232.61,69.55 0 top
R34114  10K  [0201]  232.61,70.15 0 top
R34115  10K  [0201]  232.61,70.76 0 top
R34116  10K  [0201]  232.61,71.37 0 top
R34117  10K  [0201]  232.61,71.98 0 top
R34118  10K  [0201]  232.61,72.59 0 top
R34119  10K  [0201]  232.61,73.2 0 top
R34120  10K  [0201]  232.61,73.81 0 top
R34121  10K  [0201]  232.61,74.42 0 top
R34122  10K  [0201]  232.61,75.03 0 top
R34123  10K  [0201]  232.61,75.64 0 top
R34124  10K  [0201]  232.61,76.25 0 top
R34125  10K  [0201]  232.61,76.86 0 top
R34126  10K  [0201]  232.61,77.47 0 top
R34127  10K  [0201]  232.61,78.08 0 top
R34128  10K  [0201]  232.61,78.69 0 top
R34129  10K  [0201]  232.61,79.3 0 top
R34130  10K  [0201]  232.61,79.91 0 top
R34131  10K  [0201]  232.61,80.52 0 top
R34132  10K  [0201]  232.61,81.13 0 top
R34133  10K  [0201]  232.61,81.74 0 top
R34134  10K  [0201]  232.61,82.35 0 top
R34135  10K  [0201]  232.61,82.96 0 top
R34136  10K  [0201]  232.61,83.57 0 top
R34137  10K  [0201]  232.61,84.18 0 top
R34138  10K  [0201]  232.61,84.79 0 top
R34139  10K  [0201]  232.61,85.39 0 top
R34140  10K  [0201]  232.61,86 0 top
R34141  10K  [0201]  232.61,86.61 0 top
R34142  10K  [0201]  232.61,87.22 0 top
R34143  10K  [0201]  232.61,87.83 0 top
R34144  10K  [0201]  232.61,88.44 0 top
R34145  10K  [0201]  232.61,89.05 0 top
R34146  10K  [0201]  232.61,89.66 0 top
R34147  10K  [0201]  232.61,90.27 0 top
R34148  10K  [0201]  232.61,90.88 0 top
R34149  10K  [0201]  232.61,91.49 0 top
R34150  10K  [0201]  232.61,92.1 0 top
R34151  10K  [0201]  232.61,92.71 0 top
R34152  10K  [0201]  232.61,93.32 0 top
R34153  10K  [0201]  232.61,93.93 0 top
R34154  10K  [0201]  232.61,94.54 0 top
R34155  10K  [0201]  232.61,95.15 0 top
R34156  10K  [0201]  232.61,95.76 0 top
R34157  10K  [0201]  232.61,96.37 0 top
R34158  10K  [0201]  232.61,96.98 0 top
R34159  10K  [0201]  232.61,97.59 0 top
R34160  10K  [0201]  232.61,98.2 0 top
R34161  10K  [0201]  232.61,98.81 0 top
R34162  10K  [0201]  232.61,99.42 0 top
R34163  10K  [0201]  232.61,100.03 0 top
R34164  10K  [0201]  232.61,100.63 0 top
R34165  10K  [0201]  232.61,101.24 0 top
R34166  10K  [0201]  232.61,101.85 0 top
R34167  10K  [0201]  232.61,102.46 0 top
R34168  10K  [0201]  232.61,103.07 0 top
R34169  10K  [0201]  232.61,103.68 0 top
R34170  10K  [0201]  232.61,104.29 0 top
R34171  10K  [0201]  232.61,104.9 0 top
R34172  10K  [0201]  232.61,105.51 0 top
R34173  10K  [0201]  232.61,106.12 0 top
R34174  10K  [0201]  232.61,106.73 0 top
R34175  10K  [0201]  232.61,107.34 0 top
R34176  10K  [0201]  232.61,107.95 0 top
R34177  10K  [0201]  232.61,108.56 0 top
R34178  10K  [0201]  232.61,109.17 0 top
R34179  10K  [0201]  232.61,109.78 0 top
R34180  10K  [0201]  232.61,110.39 0 top
R34181  10K  [0201]  232.61,111 0 top
R34182  10K  [0201]  232.61,111.61 0 top
R34183  10K  [0201]  232.61,112.22 0 top
R34184  10K  [0201]  232.61,112.83 0 top
R34185  10K  [0201]  232.61,113.44 0 top
R34186  10K  [0201]  232.61,114.05 0 top
R34187  10K  [0201]  232.61,114.66 0 top
R34188  10K  [0201]  232.61,115.27 0 top
R34189  10K  [0201]  232.61,115.87 0 top
R34190  10K  [0201]  232.61,116.48 0 top